# EasyEDA Pro project kuafu01_030内部老化方案_2.eprj (continued)
## Notes on the sheets (continued)
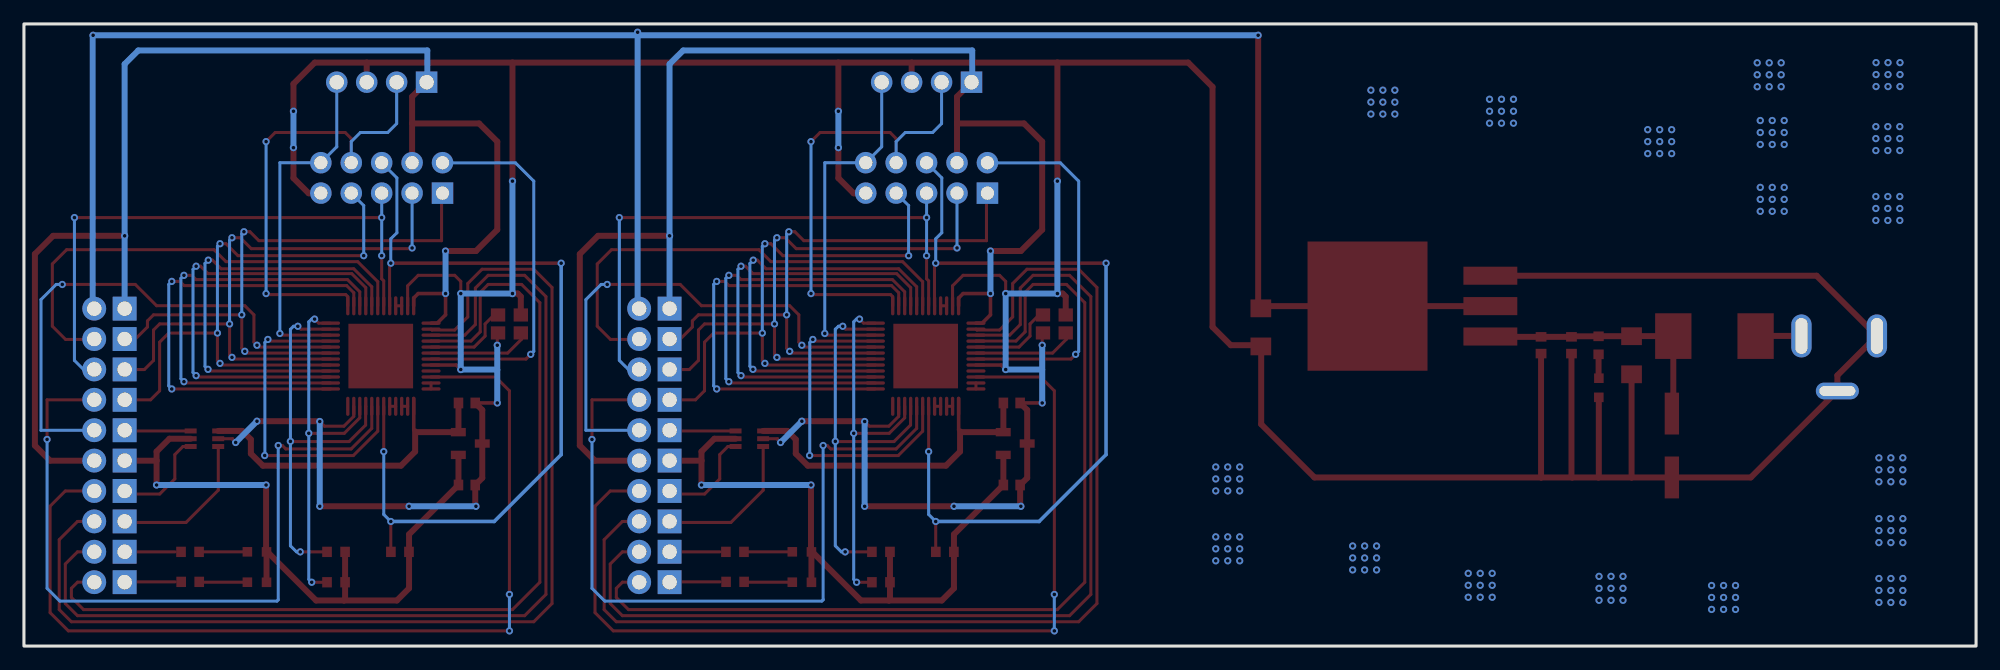
[diagram p3: board, bottom side, seen from below]

Outline 163 x 52 mm; copper layers: Top Layer, Bottom Layer. Coordinates in mm from the lower left corner of the outline.
Outline path: rectangle 0,52 163,0
Stack: Top Layer 0.035mm / Dielectric1 1.51mm FR4 er 4.5 / Bottom Layer 0.035mm

## Design rules (mm)
spacing safeClearance (default): track to track 0.152, other pairs 0.152 to 0.3
track width trackWidth (default): min 0.127, default 0.254, max 2.54
differential pair differentialPair (default): width min 0.127, default 0.254, max 2.54; gap min 0.152, default 0.152
via viaSize (default): diameter min 0.5, default 0.61, max 10; hole min 0.3, default 0.305, max 6

## Placement (name value [footprint] x y rotation side)
C1  470nF  [C0603]  80.52 13.46 180 top
C1#2  -  [C0603]  126.02 13.46 180 top
C2  10uF  [C1206]  28.76 24.31 270 top
C3  10uF  [C1206]  59.72 26.64 90 top
C4  100uF  [CAP-SMD_BD6.3-L6.6-W6.6-LS7.6-FD-1]  25.4 16.76 270 top
C5  100nF  [C0603]  33.78 25.15 90 top
C6  100nF  [C0603]  80.52 20.32 0 top
C6#2  -  [C0603]  126.02 20.32 0 top
C7  100nF  [C0603]  36.32 25.15 90 top
CN1  DS254P-2X5-L0  [IDC-TH_10P-P2.54-V-R2-C5-S2.54]  87.63 39.13 0 top
CN1#2  -  [IDC-TH_10P-P2.54-V-R2-C5-S2.54]  133.13 39.13 0 top
CN2  XH-4A  [CONN-TH_4P-P2.50_XH-4A]  87.63 47.13 0 top
CN2#2  -  [CONN-TH_4P-P2.50_XH-4A]  133.13 47.13 0 top
D1  SS36-E3/57T  [SMC_L7.1-W6.2-LS8.1-R-RD]  21.84 25.91 180 top
DC1  HX DC005 QT  [DC-IN-TH_HANXIA_HX-DC005-QT]  11.43 23.62 0 top
H1  PZ254V-11-02P  [HDR-TH_2P-P2.54-V-M]  110.36 7.88 0 top
H1#2  -  [HDR-TH_2P-P2.54-V-M]  155.86 7.88 0 top
H2  PZ254V-11-02P  [HDR-TH_2P-P2.54-V-M]  110.36 5.34 0 top
H2#2  -  [HDR-TH_2P-P2.54-V-M]  155.86 5.34 0 top
H3  PZ254V-11-02P  [HDR-TH_2P-P2.54-V-M]  110.36 25.66 0 top
H3#2  -  [HDR-TH_2P-P2.54-V-M]  155.86 25.66 0 top
H4  PZ254V-11-02P  [HDR-TH_2P-P2.54-V-M]  110.36 23.12 0 top
H4#2  -  [HDR-TH_2P-P2.54-V-M]  155.86 23.12 0 top
H5  PZ254V-11-02P  [HDR-TH_2P-P2.54-V-M]  110.36 20.58 0 top
H5#2  -  [HDR-TH_2P-P2.54-V-M]  155.86 20.58 0 top
H6  PZ254V-11-02P  [HDR-TH_2P-P2.54-V-M]  110.36 18.04 0 top
H6#2  -  [HDR-TH_2P-P2.54-V-M]  155.86 18.04 0 top
H7  PZ254V-11-02P  [HDR-TH_2P-P2.54-V-M]  110.36 10.42 0 top
H7#2  -  [HDR-TH_2P-P2.54-V-M]  155.86 10.42 0 top
H8  PZ254V-11-02P  [HDR-TH_2P-P2.54-V-M]  110.36 12.96 0 top
H8#2  -  [HDR-TH_2P-P2.54-V-M]  155.86 12.96 0 top
H9  PZ254V-11-02P  [HDR-TH_2P-P2.54-V-M]  110.36 15.5 0 top
H9#2  -  [HDR-TH_2P-P2.54-V-M]  155.86 15.5 0 top
H10  PZ254V-11-02P  [HDR-TH_2P-P2.54-V-M]  110.36 28.2 0 top
H10#2  -  [HDR-TH_2P-P2.54-V-M]  155.86 28.2 0 top
LED1  NCD0603R1  [LED0603-RD_RED]  98.04 7.87 180 top
LED1#2  -  [LED0603-RD_RED]  143.54 7.87 180 top
LED2  19-217/GHC-YR1S2/3T  [LED0603-RD]  98.04 5.33 180 top
LED2#2  -  [LED0603-RD]  143.54 5.33 180 top
LED3  19-217/GHC-YR1S2/3T  [LED0603-RD]  31.5 21.59 90 top
R1  10K  [R0603]  103.63 7.87 180 top
R1#2  -  [R0603]  149.13 7.87 180 top
R2  10K  [R0603]  103.62 5.37 180 top
R2#2  -  [R0603]  149.12 5.37 180 top
R3  150Ω  [R0603]  86.11 7.87 0 top
R3#2  -  [R0603]  131.61 7.87 0 top
R4  0603WAF4701T5E/4.7KΩ  [R0603]  91.44 7.87 0 top
R4#2  -  [R0603]  136.94 7.87 0 top
R5  0603WAF4701T5E/4.7KΩ  [R0603]  91.44 5.33 180 top
R5#2  -  [R0603]  136.94 5.33 180 top
R6  10kΩ  [R0603]  31.52 25.14 90 top
U1  REF2920AIDBZR  [SOT-23-3_L2.9-W1.3-P1.90-LS2.4-BR]  80.23 16.93 0 top
U1#2  -  [SOT-23-3_L2.9-W1.3-P1.90-LS2.4-BR]  125.73 16.93 0 top
U2  BL1551B  [SC-70-6_L2.1-W1.3-P0.65-LS2.3-BR]  102.43 17.33 180 top
U2#2  -  [SC-70-6_L2.1-W1.3-P0.65-LS2.3-BR]  147.93 17.33 180 top
U6  PT32A030C8T7  [LQFP-48_L7.0-W7.0-P0.50-LS9.0-BL-EP5.4]  87.71 24.24 270 top
U6#2  -  [LQFP-48_L7.0-W7.0-P0.50-LS9.0-BL-EP5.4]  133.21 24.24 270 top
U7  AMS1086CM-5.0  [TO-263-3_L8.6-W10.2-P2.54-LS14.4-TL]  45.68 28.41 0 top
X1  25MHz  [OSC-SMD_4P-L2.5-W2.0-BL]  76.96 26.92 180 top
X1#2  -  [OSC-SMD_4P-L2.5-W2.0-BL]  122.46 26.92 180 top

## Footprints (pads in the part's own frame, mm; a bottom-side part is the same pattern mirrored in y, then rotated)
C0603
  rect 0.8x0.9 smd: 1(-0.7,0) 2(0.7,0)
C1206
  rect 1.485x1.728 smd: 1(-1.593,0) 2(1.593,0)
CAP-SMD_BD6.3-L6.6-W6.6-LS7.6-FD-1
  rect 3.5x1.2 smd: 1(-2.67,0) 2(2.67,0)
CONN-TH_4P-P2.50_XH-4A
  rect 1.8x1.8 hole 1.199: 1(-3.751,0)
  round 1.8 hole 1.199: 2(-1.25,0) 3(1.25,0) 4(3.751,0)
DC-IN-TH_HANXIA_HX-DC005-QT
  oval 3.6x1.4 hole 3x0.8: 2(0.15,-2.3)
  oval 1.7x3.6 hole 1x3: 3(-3.15,2.3) 4(3.15,2.3)
HDR-TH_2P-P2.54-V-M
  rect 2x2 hole 1.2: 1(-1.27,0)
  round 2 hole 1.2: 2(1.27,0)
IDC-TH_10P-P2.54-V-R2-C5-S2.54
  rect 1.8x1.8 hole 1.1: 1(-5.08,-1.27)
  round 1.8 hole 1.1: 2(-5.08,1.27) 3(-2.54,-1.27) 4(-2.54,1.27) 5(0,-1.27) 6(0,1.27) 7(2.54,-1.27) 8(2.54,1.27) 9(5.08,-1.27) 10(5.08,1.27)
LED0603-RD
  rect 0.8x0.8 smd: 1(-0.799,-0.004) 2(0.799,0.004)
LED0603-RD_RED
  rect 0.8x0.8 smd: 1(-0.799,-0.004) 2(0.799,0.004)
LQFP-48_L7.0-W7.0-P0.50-LS9.0-BL-EP5.4
  oval 0.28x1.6 smd: 1(-2.75,-4.2) 2(-2.25,-4.2) 3(-1.75,-4.2) 4(-1.25,-4.2) 5(-0.75,-4.2) 6(-0.25,-4.2) 7(0.25,-4.2) 8(0.75,-4.2) 9(1.25,-4.2) 10(1.75,-4.2) 11(2.25,-4.2) 12(2.75,-4.2) 25(2.75,4.2) 26(2.25,4.2) 27(1.75,4.2) 28(1.25,4.2) 29(0.75,4.2) 30(0.25,4.2) 31(-0.25,4.2) 32(-0.75,4.2) 33(-1.25,4.2) 34(-1.75,4.2) 35(-2.25,4.2) 36(-2.75,4.2)
  oval 1.6x0.28 smd: 13(4.2,-2.75) 14(4.2,-2.25) 15(4.2,-1.75) 16(4.2,-1.25) 17(4.2,-0.75) 18(4.2,-0.25) 19(4.2,0.25) 20(4.2,0.75) 21(4.2,1.25) 22(4.2,1.75) 23(4.2,2.25) 24(4.2,2.75) 37(-4.2,2.75) 38(-4.2,2.25) 39(-4.2,1.75) 40(-4.2,1.25) 41(-4.2,0.75) 42(-4.2,0.25) 43(-4.2,-0.25) 44(-4.2,-0.75) 45(-4.2,-1.25) 46(-4.2,-1.75) 47(-4.2,-2.25) 48(-4.2,-2.75)
  rect 5.4x5.4 smd: 49(0,0)
OSC-SMD_4P-L2.5-W2.0-BL
  rect 1.2x1.1 smd: 1(-0.95,-0.75) 2(0.95,-0.75) 3(0.95,0.75) 4(-0.95,0.75)
R0603
  rect 0.806x0.864 smd: 1(-0.753,0) 2(0.753,0)
SC-70-6_L2.1-W1.3-P0.65-LS2.3-BR
  rect 1x0.42 smd: 1(1.15,-0.65) 2(1.15,0) 3(1.15,0.65) 4(-1.15,0.65) 5(-1.15,0) 6(-1.15,-0.65)
SMC_L7.1-W6.2-LS8.1-R-RD
  rect 3.03x3.82 smd: 1(3.435,0) 2(-3.435,0)
SOT-23-3_L2.9-W1.3-P1.90-LS2.4-BR
  rect 1.25x0.7 smd: 1(1,-0.95) 2(1,0.95) 3(-1,0)
TO-263-3_L8.6-W10.2-P2.54-LS14.4-TL
  rect 4.5x1.511 smd: 1(-5.128,2.54) 2(-5.128,0) 3(-5.128,-2.54)
  rect 10.02x10.8 smd: 4(5.129,0)

## Nets
2.048V: C6.2 C6#2.2 U1.2 U1#2.2 U2.1 U2#2.1 U6.13 U6#2.13
6.5V: C2.1 C4.1 C5.2 C7.2 D1.2 R6.2 U7.3
GND: C1.2 C1#2.2 C2.2 C3.1 C4.2 C5.1 C6.1 C6#2.1 C7.1 CN1.9 CN1#2.9 CN2.3 CN2#2.3 DC1.2 DC1.3 LED3.1 U1.3 U1#2.3 U2.2 U2#2.2 U6.8 U6.23 U6.47 U6#2.8 U6#2.23 U6#2.47 U7.1 X1.2 X1.4 X1#2.2 X1#2.4
LDO_5V: C3.2 H10.2 H10#2.2 U7.2 U7.4
MCU_5V: CN1.4 CN1#2.4 CN2.1 CN2#2.1 H9.2 H9#2.2 H10.1 H10#2.1 U6.1 U6.48 U6#2.1 U6#2.48
PA0/OPA1_P/CMP1_P: H8.2 H8#2.2 U6.10 U6#2.10
PA1/OPA1_N: U6.11 U6.12 U6#2.11 U6#2.12
PA4/OPA0_N: U6.14 U6.15 U6#2.14 U6#2.15
PA6/SET_ADC_ETR: U6.16 U6.17 U6#2.16 U6#2.17
PA8/TIM1_CH1/CMP2_OUT/TSTROBE: CN1.7 CN1#2.7 H5.1 H5#2.1 U6.29 U6#2.29
PA9/UART1_TX/CMP0_OUT/TDI: CN1.3 CN1#2.3 H4.1 H4#2.1 U6.30 U6#2.30
PA10/UART1_RX/CMP1_OUT/TDO: CN1.1 CN1#2.1 H3.1 H3#2.1 U6.31 U6#2.31
PA11/ENB1: H6.2 H6#2.2 U6.32 U6#2.32
PA12/TIM1_ETR: U6.19 U6.33 U6#2.19 U6#2.33
PA13/SWDIO/TAI: CN1.10 CN1#2.10 CN2.4 CN2#2.4 U6.34 U6#2.34
PA14/SWCLK/TAO: CN1.8 CN1#2.8 CN2.2 CN2#2.2 U6.37 U6#2.37
PA15/SPI1_CS: U6.25 U6.38 U6#2.25 U6#2.38
PB0/GET_BEEP: CN1.6 CN1#2.6 R3.2 R3#2.2 U6.18 U6.44 U6#2.18 U6#2.44
PB6/UART0_TX/GET_MCP1_OUT: H3.2 H3#2.2 U6.42 U6#2.42
PB7/UART0_RX/TCK: CN1.5 CN1#2.5 H4.2 H4#2.2 U6.43 U6#2.43
PB8/TIM6_CH1: U6.45 U6.46 U6#2.45 U6#2.46
PB10/I2C1_SCL/CMP0_P1: R4.2 R4#2.2 U6.21 U6.35 U6#2.21 U6#2.35
PB11/I2C1_SDA: R5.1 R5#2.1 U6.22 U6.36 U6#2.22 U6#2.36
PB13/SPI0_SCK: U6.26 U6.39 U6#2.26 U6#2.39
PB14/SPI0_MISO: U6.27 U6.40 U6#2.27 U6#2.40
PB15/SPI0_MOSI/SET_CMP2_P0: U6.28 U6.41 U6#2.28 U6#2.41
PC13/SET_CMP1_P: H7.2 H7#2.2 U6.2 U6#2.2
PC14/LED_RED: H1.2 H1#2.2 U6.3 U6#2.3
PC15/LED_GREEN: H2.2 H2#2.2 U6.4 U6#2.4
PERIPHERAL_5V: C1.1 C1#2.1 H9.1 H9#2.1 LED1.2 LED1#2.2 LED2.2 LED2#2.2 R3.1 R3#2.1 R4.1 R4#2.1 R5.2 R5#2.2 U1.1 U1#2.1 U2.5 U2#2.5
PF0/OSC_IN: U6.5 U6#2.5 X1.1 X1#2.1
PF1/OSC_OUT: U6.6 U6#2.6 X1.3 X1#2.3
PF2/TIM5_CH1/GET_CMP2_OUT: H5.2 H5#2.2 U6.20 U6#2.20
RSTN: CN1.2 CN1#2.2 U6.7 U6#2.7
$3N9153: D1.1 DC1.4
$3N9301: LED3.2 R6.1
$4N6329: LED2.1 LED2#2.1 R2.2 R2#2.2
$4N6330: LED1.1 LED1#2.1 R1.2 R1#2.2
$4N10186: H7.1 H7#2.1 U2.3 U2#2.3
$4N10193: H6.1 H6#2.1 U2.6 U2#2.6
$4N10258: H2.1 H2#2.1 R2.1 R2#2.1
$4N10262: H1.1 H1#2.1 R1.1 R1#2.1
$4N16114: H8.1 H8#2.1 U2.4 U2#2.4

Pads without a net: U6 9 24 49; U6#2 9 24 49

## Via types
v1: diameter 0.61, hole 0.305, Top Layer to Bottom Layer, 291 vias

## Routing (per net, layer and track width the routed paths; a pad name or vN(x,y) marks a point on that pad's centre or on a via; arc(x,y) is an arc through that point)
2.048V: length 58.6
  Top Layer w0.3: 84.95,20.69 84.95,18.06 84.84,17.94 ; 130.34,17.94 130.45,18.06 130.45,20.69
  Top Layer w0.5: 84.84,17.94 84.84,16.26 86.01,15.08 97.55,15.08 98.55,16.08 98.55,17.27 99.26,17.98 U2.1 ; 130.27,17.88 U1#2.2 126.72,17.89 C6#2.2 ; C6.2 81.22,17.89 U1.2 84.77,17.88 ; 130.34,17.94 130.34,16.26 131.51,15.08 143.05,15.08 144.05,16.08 144.05,17.27 144.76,17.98 U2#2.1
6.5V: length 21.8
  Top Layer w0.5: C4.1 25.28,19.55 D1.2 28.76,25.91 C2.1 31.51,25.9 R6.2 33.74,25.89 C5.2 C7.2 40.53,25.85 U7.3
GND: length 457.9
  Top Layer w0.254: U6#2.23 135.46,19.2 136.28,18.38 137.91,18.38 v1(138.3,18.77) ; v1(123.48,25.15) 123.48,26.11 X1#2.4 ; v1(77.98,25.15) 77.98,26.11 X1.4 ; v1(126.53,29.46) 126.53,30.48 127.03,30.99 130.08,30.99 130.96,30.11 130.96,28.44 U6#2.47 ; U2.2 100.08,17.33 100.08,17.27 v1(99.82,17.02) ; v1(145.32,17.02) 145.58,17.27 145.58,17.33 U2#2.2 ; U6.47 85.46,28.44 85.46,30.11 84.58,30.99 81.53,30.99 81.03,30.48 v1(81.03,29.46) ; v1(92.8,18.77) 92.41,18.38 90.78,18.38 89.96,19.2 U6.23
  Top Layer w0.3: v1(77.98,20.32) C6.1 ; v1(123.48,20.32) C6#2.1 ; U6.8 81.4,23.49 v1(81.03,23.11) ; U6#2.8 126.9,23.49 v1(126.53,23.11)
  Top Layer w0.5: C6.1 79.23,19.73 U1.3 79.23,14.05 C1.2 79.82,11.75 v1(79.76,11.68) ; v1(138.3,18.77) 138.33,18.8 v1(143.54,18.8) ; v1(138.3,11.68) v1(130.84,11.68) ; X1#2.2 121.51,29.21 121.77,29.46 v1(122.21,29.46) ; v1(76.71,29.46) 76.27,29.46 76.01,29.21 X1.2 ; C5.1 33.78,14.15 33.73,14.09 ; v1(140.5,41.66) 140.5,39.12 139.23,37.85 138.22,37.85 CN1#2.9 ; 76.71,48.77 88.88,48.77 ; 76.71,48.77 v1(76.71,38.86) ; 76.71,48.77 65.79,48.77 63.75,46.74 63.75,26.67 62.23,25.15 59.82,25.15 C3.1 59.69,25.01 59.69,18.54 55.24,14.09 36.31,14.09 ; 88.88,48.77 95,48.77 ; 88.88,48.77 CN2.3 ; 95,48.77 122.21,48.77 ; 95,48.77 v1(95,44.7) ; 33.73,14.09 36.31,14.09 ; 33.73,14.09 31.53,14.09 ; C2.2 28.76,14.1 28.75,14.09 ; 36.31,14.09 36.32,14.11 C7.1 ; CN1.9 92.72,37.85 93.73,37.85 95,39.12 v1(95,41.66) ; LED3.1 31.5,14.13 31.53,14.09 ; CN2#2.3 134.38,48.77 ; 134.38,48.77 138.72,48.77 140.5,46.99 v1(140.5,44.7) ; 134.38,48.77 122.21,48.77 ; U7.1 13.31,30.95 DC1.3 11.58,22.62 DC1.2 18.81,14.09 C4.2 28.75,14.09 ; v1(92.8,18.77) 92.83,18.8 v1(98.04,18.8) ; 122.21,48.77 v1(122.21,38.86) ; 28.75,14.09 31.53,14.09 ; C6#2.1 124.73,19.73 U1#2.3 124.73,14.05 C1#2.2 125.32,11.75 v1(125.26,11.68) ; v1(92.8,11.68) v1(85.34,11.68)
  Bottom Layer w0.5: v1(77.98,25.15) 77.98,23.1 ; 77.98,23.1 77.99,23.11 v1(81.03,23.11) v1(81.03,29.46) v1(76.71,29.46) v1(76.71,38.86) ; 77.98,23.1 v1(77.98,20.32) ; v1(123.48,25.15) 123.48,23.1 ; 123.48,23.1 v1(123.48,20.32) ; 123.48,23.1 123.49,23.11 v1(126.53,23.11) v1(126.53,29.46) v1(122.21,29.46) v1(122.21,38.86) ; v1(85.34,11.68) v1(79.76,11.68) ; v1(98.04,18.8) v1(99.82,17.02) ; v1(130.84,11.68) v1(125.26,11.68) ; v1(143.54,18.8) v1(145.32,17.02) ; v1(140.5,44.7) v1(140.5,41.66) ; v1(92.8,18.77) v1(92.8,11.68) ; v1(95,44.7) v1(95,41.66) ; v1(138.3,18.77) v1(138.3,11.68)
  vias: v1(6.11,15.73) v1(6.11,14.73) v1(6.11,13.73) v1(6.11,10.65) v1(6.11,9.65) v1(6.11,8.65) v1(6.11,5.65) v1(6.11,4.65) v1(6.11,3.65) v1(6.35,48.77) v1(6.35,47.77) v1(6.35,46.77) v1(6.37,43.42) v1(6.37,42.42) v1(6.37,41.42) v1(6.37,37.58) v1(6.37,36.58) v1(6.37,35.58) v1(7.11,15.73) v1(7.11,14.73) v1(7.11,13.73) v1(7.11,10.65) v1(7.11,9.65) v1(7.11,8.65) v1(7.11,5.65) v1(7.11,4.65) v1(7.11,3.65) v1(7.35,48.77) v1(7.35,47.77) v1(7.35,46.77) v1(7.37,43.42) v1(7.37,42.42) v1(7.37,41.42) v1(7.37,37.58) v1(7.37,36.58) v1(7.37,35.58) v1(8.11,15.73) v1(8.11,14.73) v1(8.11,13.73) v1(8.11,10.65) v1(8.11,9.65) v1(8.11,8.65) v1(8.11,5.65) v1(8.11,4.65) v1(8.11,3.65) v1(8.35,48.77) v1(8.35,47.77) v1(8.35,46.77) v1(8.37,43.42) v1(8.37,42.42) v1(8.37,41.42) v1(8.37,37.58) v1(8.37,36.58) v1(8.37,35.58) v1(16.02,43.93) v1(16.02,42.93) v1(16.02,41.93) v1(16.02,38.34) v1(16.02,37.34) v1(16.02,36.34) v1(16.27,48.75) v1(16.27,47.75) v1(16.27,46.75) v1(17.02,43.93) v1(17.02,42.93) v1(17.02,41.93) v1(17.02,38.34) v1(17.02,37.34) v1(17.02,36.34) v1(17.27,48.75) v1(17.27,47.75) v1(17.27,46.75) v1(18.02,43.93) v1(18.02,42.93) v1(18.02,41.93) v1(18.02,38.34) v1(18.02,37.34) v1(18.02,36.34) v1(18.27,48.75) v1(18.27,47.75) v1(18.27,46.75) v1(20.08,5.06) v1(20.08,4.06) v1(20.08,3.06) v1(21.08,5.06) v1(21.08,4.06) v1(21.08,3.06) v1(22.08,5.06) v1(22.08,4.06) v1(22.08,3.06) v1(25.42,43.16) v1(25.42,42.16) v1(25.42,41.16) v1(26.42,43.16) v1(26.42,42.16) v1(26.42,41.16) v1(27.42,43.16) v1(27.42,42.16) v1(27.42,41.16) v1(29.48,5.83) v1(29.48,4.83) v1(29.48,3.83) v1(30.48,5.83) v1(30.48,4.83) v1(30.48,3.83) v1(31.48,5.83) v1(31.48,4.83) v1(31.48,3.83) v1(38.62,45.7) v1(38.62,44.7) v1(38.62,43.7) v1(39.62,45.7) v1(39.62,44.7) v1(39.62,43.7) v1(40.4,6.08) v1(40.4,5.08) v1(40.4,4.08) v1(40.62,45.7) v1(40.62,44.7) v1(40.62,43.7) v1(41.4,6.08) v1(41.4,5.08) v1(41.4,4.08) v1(42.4,6.08) v1(42.4,5.08) v1(42.4,4.08) v1(48.53,46.47) v1(48.53,45.47) v1(48.53,44.47) v1(49.53,46.47) v1(49.53,45.47) v1(49.53,44.47) v1(50.05,8.37) v1(50.05,7.37) v1(50.05,6.37) v1(50.53,46.47) v1(50.53,45.47) v1(50.53,44.47) v1(51.05,8.37) v1(51.05,7.37) v1(51.05,6.37) v1(52.05,8.37) v1(52.05,7.37) v1(52.05,6.37) v1(61.48,14.97) v1(61.48,13.97) v1(61.48,12.97) v1(61.48,9.13) v1(61.48,8.13) v1(61.48,7.13) v1(62.48,14.97) v1(62.48,13.97) v1(62.48,12.97) v1(62.48,9.13) v1(62.48,8.13) v1(62.48,7.13) v1(63.48,14.97) v1(63.48,13.97) v1(63.48,12.97) v1(63.48,9.13) v1(63.48,8.13) v1(63.48,7.13)
LDO_5V: length 185.5
  Top Layer w0.5: U7.2 U7.4 59.53,28.41 C3.2 59.94,28.45 v1(59.94,51.05)
  Bottom Layer w0.5: v1(59.94,51.05) v1(157.23,51.05) 157.26,51.02 157.26,28.33 H10#2.2 ; v1(111.76,51.31) 111.76,28.33 H10.2
MCU_5V: length 232.3
  Top Layer w0.3: U6.1 82.99,26.99 82.3,27.69 v1(82.3,29.46) 84.58,29.46 84.96,29.09 U6.48 ; U6#2.1 128.49,26.99 127.8,27.69 v1(127.8,29.46) 130.08,29.46 130.46,29.09 U6#2.48
  Top Layer w0.5: 130.59,43.68 125,43.68 123.48,42.16 123.48,34.8 125.26,33.02 v1(127.8,33.02) ; 130.59,43.68 130.59,45.92 CN2#2.1 ; 130.59,43.68 CN1#2.4 ; 85.09,43.68 79.5,43.68 77.98,42.16 77.98,34.8 79.76,33.02 v1(82.3,33.02) ; 85.09,43.68 85.09,45.92 CN2.1 ; 85.09,43.68 CN1.4 ; H9.2 111.64,15.49 115.32,15.49 116.59,16.76 116.59,32.77 115.06,34.29 v1(109.09,34.29) ; H9#2.2 157.14,15.49 160.82,15.49 162.09,16.76 162.09,32.77 160.56,34.29 v1(154.59,34.29)
  Bottom Layer w0.5: CN2#2.1 129.32,47.19 129.32,49.78 153.45,49.78 154.59,48.64 v1(154.59,34.29) H10#2.1 ; v1(127.8,33.02) v1(127.8,29.46) ; H10.1 v1(109.09,34.29) 109.09,48.64 107.95,49.78 83.82,49.78 83.82,47.19 CN2.1 ; v1(82.3,33.02) v1(82.3,29.46)
PA0/OPA1_P/CMP1_P: length 158.4
  Top Layer w0.254: U6.10 78.12,22.49 76.96,21.34 v1(76.96,4.32) ; H8.2 114.05,12.96 115.32,11.69 115.32,2.79 113.79,1.27 v1(76.96,1.27) ; v1(122.46,4.32) 122.46,21.34 123.62,22.49 U6#2.10 ; v1(122.46,1.27) 159.29,1.27 160.82,2.79 160.82,11.69 159.55,12.96 H8#2.2
  Bottom Layer w0.254: v1(76.96,1.27) v1(76.96,4.32) ; v1(122.46,1.27) v1(122.46,4.32)
PA1/OPA1_N: length 1
  Top Layer w0.254: U6#2.12 U6#2.11 ; U6.12 U6.11
PA4/OPA0_N: length 1
  Top Layer w0.254: U6.15 U6.14 ; U6#2.15 U6#2.14
PA6/SET_ADC_ETR: length 1
  Top Layer w0.254: U6#2.17 U6#2.16 ; U6.17 U6.16
PA8/TIM1_CH1/CMP2_OUT/TSTROBE: length 99.9
  Top Layer w0.254: U6#2.29 146.49,23.49 v1(146.63,23.63) 146.85,23.85 v1(146.85,26.16) 150.91,26.16 151.67,25.4 151.67,21.34 152.43,20.58 H5#2.1 ; H5.1 106.93,20.58 106.17,21.34 106.17,25.4 105.41,26.16 v1(101.35,26.16) 101.35,23.85 v1(101.13,23.63) 100.99,23.49 U6.29 ; v1(89.13,32.63) 99.63,32.63 100.63,33.63 v1(101.13,33.63) ; v1(146.63,33.63) 146.13,33.63 145.13,32.63 v1(134.63,32.63)
  Bottom Layer w0.254: v1(101.13,33.63) 101.35,33.41 v1(101.35,26.16) ; v1(89.13,32.63) 89.13,36.82 CN1.7 ; CN1#2.7 134.63,36.82 v1(134.63,32.63) ; v1(146.63,33.63) 146.85,33.41 v1(146.85,26.16)
PA9/UART1_TX/CMP0_OUT/TDI: length 100.6
  Top Layer w0.254: U6#2.30 145.49,23.99 v1(145.63,24.13) 145.83,24.33 v1(145.83,26.92) 151.67,26.92 152.18,26.42 152.18,23.88 152.94,23.11 154.58,23.11 H4#2.1 ; H4.1 109.08,23.11 107.44,23.11 106.68,23.88 106.68,26.42 106.17,26.92 v1(100.33,26.92) 100.33,24.33 v1(100.13,24.13) 99.99,23.99 U6.30 ; v1(85.09,33.27) 85.15,33.21 98.52,33.21 99.43,34.13 v1(100.13,34.13) ; v1(130.59,33.27) 130.65,33.21 144.02,33.21 144.93,34.13 v1(145.63,34.13)
  Bottom Layer w0.254: CN1.3 v1(85.09,33.27) ; v1(100.33,26.92) 100.33,33.93 v1(100.13,34.13) ; CN1#2.3 v1(130.59,33.27) ; v1(145.63,34.13) 145.83,33.93 v1(145.83,26.92)
PA10/UART1_RX/CMP1_OUT/TDO: length 98.3
  Top Layer w0.254: U6#2.31 144.41,24.49 v1(144.56,24.64) 144.81,24.89 v1(144.81,27.69) 152.18,27.69 152.69,27.18 152.69,26.67 153.7,25.65 154.58,25.65 H3#2.1 ; CN1.1 82.63,37.78 82.63,33.88 97.88,33.88 98.63,34.63 v1(99.13,34.63) ; CN1#2.1 128.13,37.78 128.13,33.88 143.38,33.88 144.13,34.63 v1(144.63,34.63) ; H3.1 109.08,25.65 108.2,25.65 107.19,26.67 107.19,27.18 106.68,27.69 v1(99.31,27.69) 99.31,24.89 v1(99.06,24.64) 98.91,24.49 U6.31
  Bottom Layer w0.254: v1(99.31,27.69) 99.31,34.45 v1(99.13,34.63) ; v1(144.63,34.63) 144.81,34.45 v1(144.81,27.69)
PA11/ENB1: length 87.2
  Top Layer w0.254: U6.32 97.89,24.99 v1(98.04,25.15) 98.3,25.4 98.3,27.69 99.06,28.45 106.43,28.45 108.2,30.23 v1(114.3,30.23) ; U6#2.32 143.39,24.99 v1(143.54,25.15) 143.8,25.4 143.8,27.69 144.56,28.45 151.93,28.45 153.7,30.23 v1(159.8,30.23)
  Bottom Layer w0.254: v1(159.8,30.23) 160.31,30.23 161.58,28.96 161.58,18.03 157.14,18.03 H6#2.2 ; H6.2 111.64,18.03 116.08,18.03 116.08,28.96 114.81,30.23 v1(114.3,30.23)
PA12/TIM1_ETR: length 54.9
  Top Layer w0.254: U6.19 87.96,17.96 90,15.92 97.39,15.92 v1(97.4,15.93) ; U6#2.19 133.46,17.96 135.5,15.92 142.89,15.92 v1(142.9,15.93) ; U6.33 96.99,25.49 v1(97.13,25.63) ; v1(142.63,25.63) 142.49,25.49 U6#2.33
  Bottom Layer w0.254: v1(142.9,15.93) 142.88,15.94 142.88,25.38 v1(142.63,25.63) ; v1(97.13,25.63) 97.38,25.38 97.38,15.94 v1(97.4,15.93)
PA13/SWDIO/TAI: length 58.5
  Top Layer w0.254: v1(141.63,26.13) 141.49,25.99 U6#2.34 ; v1(96.13,26.13) 95.99,25.99 U6.34
  Bottom Layer w0.254: CN2#2.4 136.88,41.73 CN1#2.10 141.63,40.4 v1(141.63,26.13) ; v1(96.13,26.13) 96.13,40.4 CN1.10 91.38,41.73 CN2.4
PA14/SWCLK/TAO: length 79.4
  Top Layer w0.254: U6.37 90.46,29.2 90.63,29.38 97.19,29.38 v1(97.28,29.46) ; U6#2.37 135.96,29.2 136.13,29.38 142.69,29.38 v1(142.78,29.46) ; CN1#2.8 135.67,42.42 136.18,42.93 142.02,42.93 v1(142.78,42.16) ; CN1.8 90.17,42.42 90.68,42.93 96.52,42.93 v1(97.28,42.16)
  Bottom Layer w0.254: v1(142.78,42.16) v1(142.78,29.46) ; v1(97.28,42.16) v1(97.28,29.46) ; CN2#2.2 131.88,43.67 132.62,42.93 134.91,42.93 135.67,42.16 CN1#2.8 ; CN2.2 86.38,43.67 87.12,42.93 89.41,42.93 90.17,42.16 CN1.8
PA15/SPI1_CS: length 78.3
  Top Layer w0.254: U6#2.38 135.46,29.53 136.06,30.13 149.63,30.13 149.98,30.48 v1(150.66,30.48) ; U6.25 v1(105.16,21.49) ; U6#2.25 v1(150.66,21.49) ; U6.38 89.96,29.53 90.56,30.13 104.13,30.13 104.48,30.48 v1(105.16,30.48)
  Bottom Layer w0.254: v1(105.16,30.48) 105.41,30.23 105.41,21.74 v1(105.16,21.49) ; v1(150.66,21.49) 150.91,21.74 150.91,30.23 v1(150.66,30.48)
PB0/GET_BEEP: length 143.8
  Top Layer w0.254: U6#2.44 132.47,28.45 132.47,31.9 v1(132.37,32) ; v1(132.37,10.41) 132.37,7.88 R3#2.2 ; v1(86.87,10.41) 86.87,7.88 R3.2 ; U6#2.18 v1(132.96,16.26) ; U6.44 86.97,28.45 86.97,31.9 v1(86.87,32) ; U6.18 v1(87.46,16.26)
  Top Layer w0.3: v1(86.87,32) v1(72.64,32) ; v1(132.37,32) v1(118.14,32)
  Bottom Layer w0.254: v1(86.87,32) 86.87,34.04 86.36,34.54 86.36,39.13 CN1.6 ; v1(132.37,10.41) 132.96,11 v1(132.96,16.26) ; v1(132.37,32) 132.37,34.04 131.86,34.54 131.86,39.13 CN1#2.6 ; v1(86.87,10.41) 87.46,11 v1(87.46,16.26)
  Bottom Layer w0.3: v1(72.64,32) 72.64,16 78.23,10.41 v1(86.87,10.41) ; v1(118.14,32) 118.14,16 123.73,10.41 v1(132.37,10.41)
PB6/UART0_TX/GET_MCP1_OUT: length 79.9
  Top Layer w0.254: H3.2 111.66,25.63 114.02,25.63 115.13,26.74 115.13,31.94 113.94,33.13 101.63,33.13 100.63,32.13 89.63,32.13 87.96,30.46 U6.42 ; H3#2.2 157.16,25.63 159.52,25.63 160.63,26.74 160.63,31.94 159.44,33.13 147.13,33.13 146.13,32.13 135.13,32.13 133.46,30.46 U6#2.42
PB7/UART0_RX/TCK: length 98.1
  Top Layer w0.254: U6#2.43 132.96,30.53 133.13,30.7 v1(133.13,32.63) ; v1(158.78,35.81) v1(133.13,35.81) ; U6.43 87.46,30.53 87.63,30.7 v1(87.63,32.63) ; v1(113.28,35.81) v1(87.63,35.81)
  Bottom Layer w0.254: v1(87.63,32.63) v1(87.63,35.81) CN1.5 ; v1(133.13,32.63) v1(133.13,35.81) CN1#2.5 ; H4.2 112.53,23.12 113.28,23.88 v1(113.28,35.81) ; v1(158.78,35.81) 158.78,23.88 158.03,23.12 H4#2.2
PB8/TIM6_CH1: length 1
  Top Layer w0.254: U6.46 U6.45 ; U6#2.46 U6#2.45
PB10/I2C1_SCL/CMP0_P1: length 66.7
  Top Layer w0.254: U6#2.21 134.47,20.03 134.47,18.47 135.85,17.09 140.73,17.09 v1(140.75,17.11) ; v1(94.43,7.87) R4.2 ; U6#2.35 139.89,26.49 v1(140.13,26.73) ; U6.35 94.39,26.49 v1(94.63,26.73) ; U6.21 88.97,20.03 88.97,18.47 90.35,17.09 95.23,17.09 v1(95.25,17.11) ; v1(139.93,7.87) R4#2.2
  Bottom Layer w0.254: v1(139.93,7.87) 140.24,7.87 140.75,8.38 v1(140.75,17.11) 140.75,26.48 140.5,26.73 v1(140.13,26.73) ; v1(94.63,26.73) 95,26.73 95.25,26.48 v1(95.25,17.11) 95.25,8.38 94.74,7.87 v1(94.43,7.87)
PB11/I2C1_SDA: length 61.9
  Top Layer w0.254: v1(93.23,27.33) 92.89,26.99 U6.36 ; U6#2.36 138.39,26.99 v1(138.73,27.33) ; U6.22 89.46,19.08 90.75,17.78 93.71,17.78 v1(93.72,17.79) ; U6#2.22 134.96,19.08 136.25,17.78 139.21,17.78 v1(139.22,17.79) ; v1(93.47,5.33) R5.1 ; v1(138.97,5.33) R5#2.1
  Bottom Layer w0.254: v1(93.23,27.33) 93.48,27.33 93.72,27.1 v1(93.72,17.79) 93.72,5.58 v1(93.47,5.33) ; v1(138.73,27.33) 138.98,27.33 139.22,27.1 v1(139.22,17.79) 139.22,5.58 v1(138.97,5.33)
PB13/SPI0_SCK: length 75.6
  Top Layer w0.254: v1(104.14,30.99) 103.49,30.99 103.13,30.63 90.48,30.63 89.46,29.61 U6.39 ; v1(104.14,22.1) 104.03,21.99 U6.26 ; v1(149.64,30.99) 148.99,30.99 148.63,30.63 135.98,30.63 134.96,29.61 U6#2.39 ; U6#2.26 149.53,21.99 v1(149.64,22.1)
  Bottom Layer w0.254: v1(149.64,30.99) 149.89,30.73 149.89,22.35 v1(149.64,22.1) ; v1(104.14,22.1) 104.39,22.35 104.39,30.73 v1(104.14,30.99)
PB14/SPI0_MISO: length 74.1
  Top Layer w0.254: U6.27 103.01,22.49 v1(103.12,22.61) ; v1(103.12,31.75) 102.75,31.75 102.13,31.13 90.13,31.13 88.96,29.96 U6.40 ; v1(148.62,22.61) 148.51,22.49 U6#2.27 ; v1(148.62,31.75) 148.25,31.75 147.63,31.13 135.63,31.13 134.46,29.96 U6#2.40
  Bottom Layer w0.254: v1(103.12,22.61) 103.38,22.87 103.38,31.49 v1(103.12,31.75) ; v1(148.62,31.75) 148.88,31.49 148.88,22.87 v1(148.62,22.61)
PB15/SPI0_MOSI/SET_CMP2_P0: length 71.6
  Top Layer w0.254: U6.41 88.46,30.03 89.96,31.54 101.04,31.54 101.76,32.26 v1(102.11,32.26) ; v1(147.61,32.26) 147.26,32.26 146.54,31.54 135.46,31.54 133.96,30.03 U6#2.41 ; U6#2.28 147.49,22.99 v1(147.63,23.13) ; U6.28 101.99,22.99 v1(102.13,23.13)
  Bottom Layer w0.254: v1(147.61,32.26) 147.88,31.98 147.88,23.38 v1(147.63,23.13) ; v1(102.13,23.13) 102.38,23.38 102.38,31.98 v1(102.11,32.26)
PC13/SET_CMP1_P: length 185
  Top Layer w0.254: U6.2 83.43,26.42 81.53,26.42 80.44,27.51 80.44,30.3 79.25,31.5 74.93,31.5 73.41,29.97 73.41,3.56 74.93,2.03 113.54,2.03 114.55,3.05 114.55,8.89 113.03,10.41 111.64,10.41 H7.2 ; U6#2.2 128.93,26.42 127.03,26.42 125.94,27.51 125.94,30.3 124.75,31.5 120.43,31.5 118.91,29.97 118.91,3.56 120.43,2.03 159.04,2.03 160.05,3.05 160.05,8.89 158.53,10.41 157.14,10.41 H7#2.2
PC14/LED_RED: length 173
  Top Layer w0.254: H1#2.2 157.14,7.87 158.53,7.87 159.55,6.86 159.55,3.56 158.53,2.54 121.19,2.54 119.41,4.32 119.41,29.21 121.19,30.99 124.24,30.99 125.31,29.92 125.31,26.87 126.19,25.99 U6#2.3 ; H1.2 111.64,7.87 113.03,7.87 114.05,6.86 114.05,3.56 113.03,2.54 75.69,2.54 73.91,4.32 73.91,29.21 75.69,30.99 78.74,30.99 79.81,29.92 79.81,26.87 80.69,25.99 U6.3
PC15/LED_GREEN: length 160.7
  Top Layer w0.254: H2#2.2 158.52,5.34 159.04,4.83 159.04,4.06 158.02,3.05 122.21,3.05 119.92,5.33 119.92,28.7 121.45,30.23 124.24,30.23 124.9,29.57 124.9,26.26 125.67,25.5 129,25.5 U6#2.4 ; U6.4 83.5,25.5 80.17,25.5 79.4,26.26 79.4,29.57 78.74,30.23 75.95,30.23 74.42,28.7 74.42,5.33 76.71,3.05 112.52,3.05 113.54,4.06 113.54,4.83 113.02,5.34 H2.2
PERIPHERAL_5V: length 114.1
  Top Layer w0.5: 136.28,3.81 136.19,3.9 R5#2.2 R4#2.1 ; 136.28,3.81 138.61,3.81 142.71,7.91 LED1#2.2 ; 136.28,3.81 131.86,3.81 130.84,4.83 130.84,7.87 ; v1(151.93,13.46) 151.93,15.49 ; 151.93,15.49 154.58,15.49 H9#2.1 ; 151.93,15.49 151.93,16.26 150.85,17.33 U2#2.5 ; 85.34,7.87 85.34,4.83 86.36,3.81 90.78,3.81 ; 85.34,7.87 R3.1 ; 85.34,7.87 85.34,9.34 C1.1 81.22,15.97 U1.1 ; LED1.2 97.21,7.91 93.11,3.81 90.78,3.81 ; LED1.2 97.28,7.91 v1(97.28,13.46) ; LED1.2 LED2.2 ; LED1#2.2 LED2#2.2 ; LED1#2.2 142.78,7.91 v1(142.78,13.46) ; U2.5 105.35,17.33 106.43,16.26 106.43,15.49 ; 130.84,7.87 R3#2.1 ; 130.84,7.87 130.84,9.34 C1#2.1 126.72,15.97 U1#2.1 ; 106.43,15.49 v1(106.43,13.46) ; 106.43,15.49 109.08,15.49 H9.1 ; 90.78,3.81 90.69,3.9 R5.2 R4.1
  Bottom Layer w0.5: v1(142.78,13.46) v1(151.93,13.46) ; v1(97.28,13.46) v1(106.43,13.46)
PF0/OSC_IN: length 14.6
  Top Layer w0.254: U6#2.5 125.41,24.99 124.49,25.91 124.49,26.92 123.74,27.67 X1#2.1 ; X1.1 78.24,27.67 78.99,26.92 78.99,25.91 79.91,24.99 U6.5
PF1/OSC_OUT: length 17.2
  Top Layer w0.254: X1#2.3 121.45,26.11 121.45,25.65 122.61,24.49 U6#2.6 ; U6.6 77.11,24.49 75.95,25.65 75.95,26.11 X1.3
PF2/TIM5_CH1/GET_CMP2_OUT: length 125.7
  Top Layer w0.254: H5.2 115.57,20.58 v1(115.57,17.27) ; v1(141.77,16.76) 141.42,16.76 141.14,16.48 135.68,16.48 133.96,18.19 U6#2.20 ; v1(96.27,16.76) 95.92,16.76 95.64,16.48 90.18,16.48 88.46,18.19 U6.20 ; H5#2.2 161.07,20.58 v1(161.07,17.27)
  Bottom Layer w0.254: v1(96.27,16.76) 96.27,3.87 96.37,3.76 114.5,3.76 115.57,4.83 v1(115.57,17.27) ; v1(141.77,16.76) 141.77,3.87 141.87,3.76 160,3.76 161.07,4.83 v1(161.07,17.27)
RSTN: length 62.7
  Top Layer w0.254: U6#2.7 121.08,23.99 v1(120.68,24.38) ; U6.7 75.58,23.99 v1(75.18,24.38)
  Bottom Layer w0.254: v1(120.68,24.38) 120.43,24.64 120.43,38.86 121.95,40.39 128.04,40.39 CN1#2.2 ; v1(75.18,24.38) 74.93,24.64 74.93,38.86 76.45,40.39 82.54,40.39 CN1.2
$3N9153: length 3.8
  Top Layer w0.5: DC1.4 18.4,25.92 D1.1
$3N9301: length 2
  Top Layer w0.5: R6.1 31.52,22.42 LED3.2
$4N6329: length 8.1
  Top Layer w0.254: R2.2 102.84,5.34 LED2.1 ; LED2#2.1 148.34,5.34 R2#2.2
$4N6330: length 8.1
  Top Layer w0.254: R1#2.2 148.38,7.88 LED1#2.1 ; R1.2 102.88,7.88 LED1.1
$4N10186: length 25.3
  Top Layer w0.254: H7#2.1 154.5,10.33 149.47,10.33 146.77,13.03 146.77,16.67 U2#2.3 ; U2.3 101.27,16.67 101.27,13.03 103.97,10.33 109,10.33 H7.1
$4N10193: length 11.1
  Top Layer w0.254: U2#2.6 154.53,17.98 H6#2.1 ; H6.1 109.03,17.98 U2.6
$4N10258: length 8.4
  Top Layer w0.254: 150.38,5.37 154.57,5.37 H2#2.1 ; 104.88,5.37 109.07,5.37 H2.1
$4N10262: length 8.4
  Top Layer w0.254: 104.89,7.87 109.08,7.87 H1.1 ; 150.39,7.87 154.58,7.87 H1#2.1
$4N16114: length 16.9
  Top Layer w0.254: H8.1 108.84,12.71 106.16,12.71 104.9,13.97 104.9,16 104.22,16.68 U2.4 ; U2#2.4 149.72,16.68 150.4,16 150.4,13.97 151.66,12.71 154.34,12.71 H8#2.1
